# Altium schematic sheet GridSeed.SchDoc (part 1 of 2)
size A0; DocumentNumber: 1; SheetNumber: 1; SheetTotal: 1; SheetSize: A3
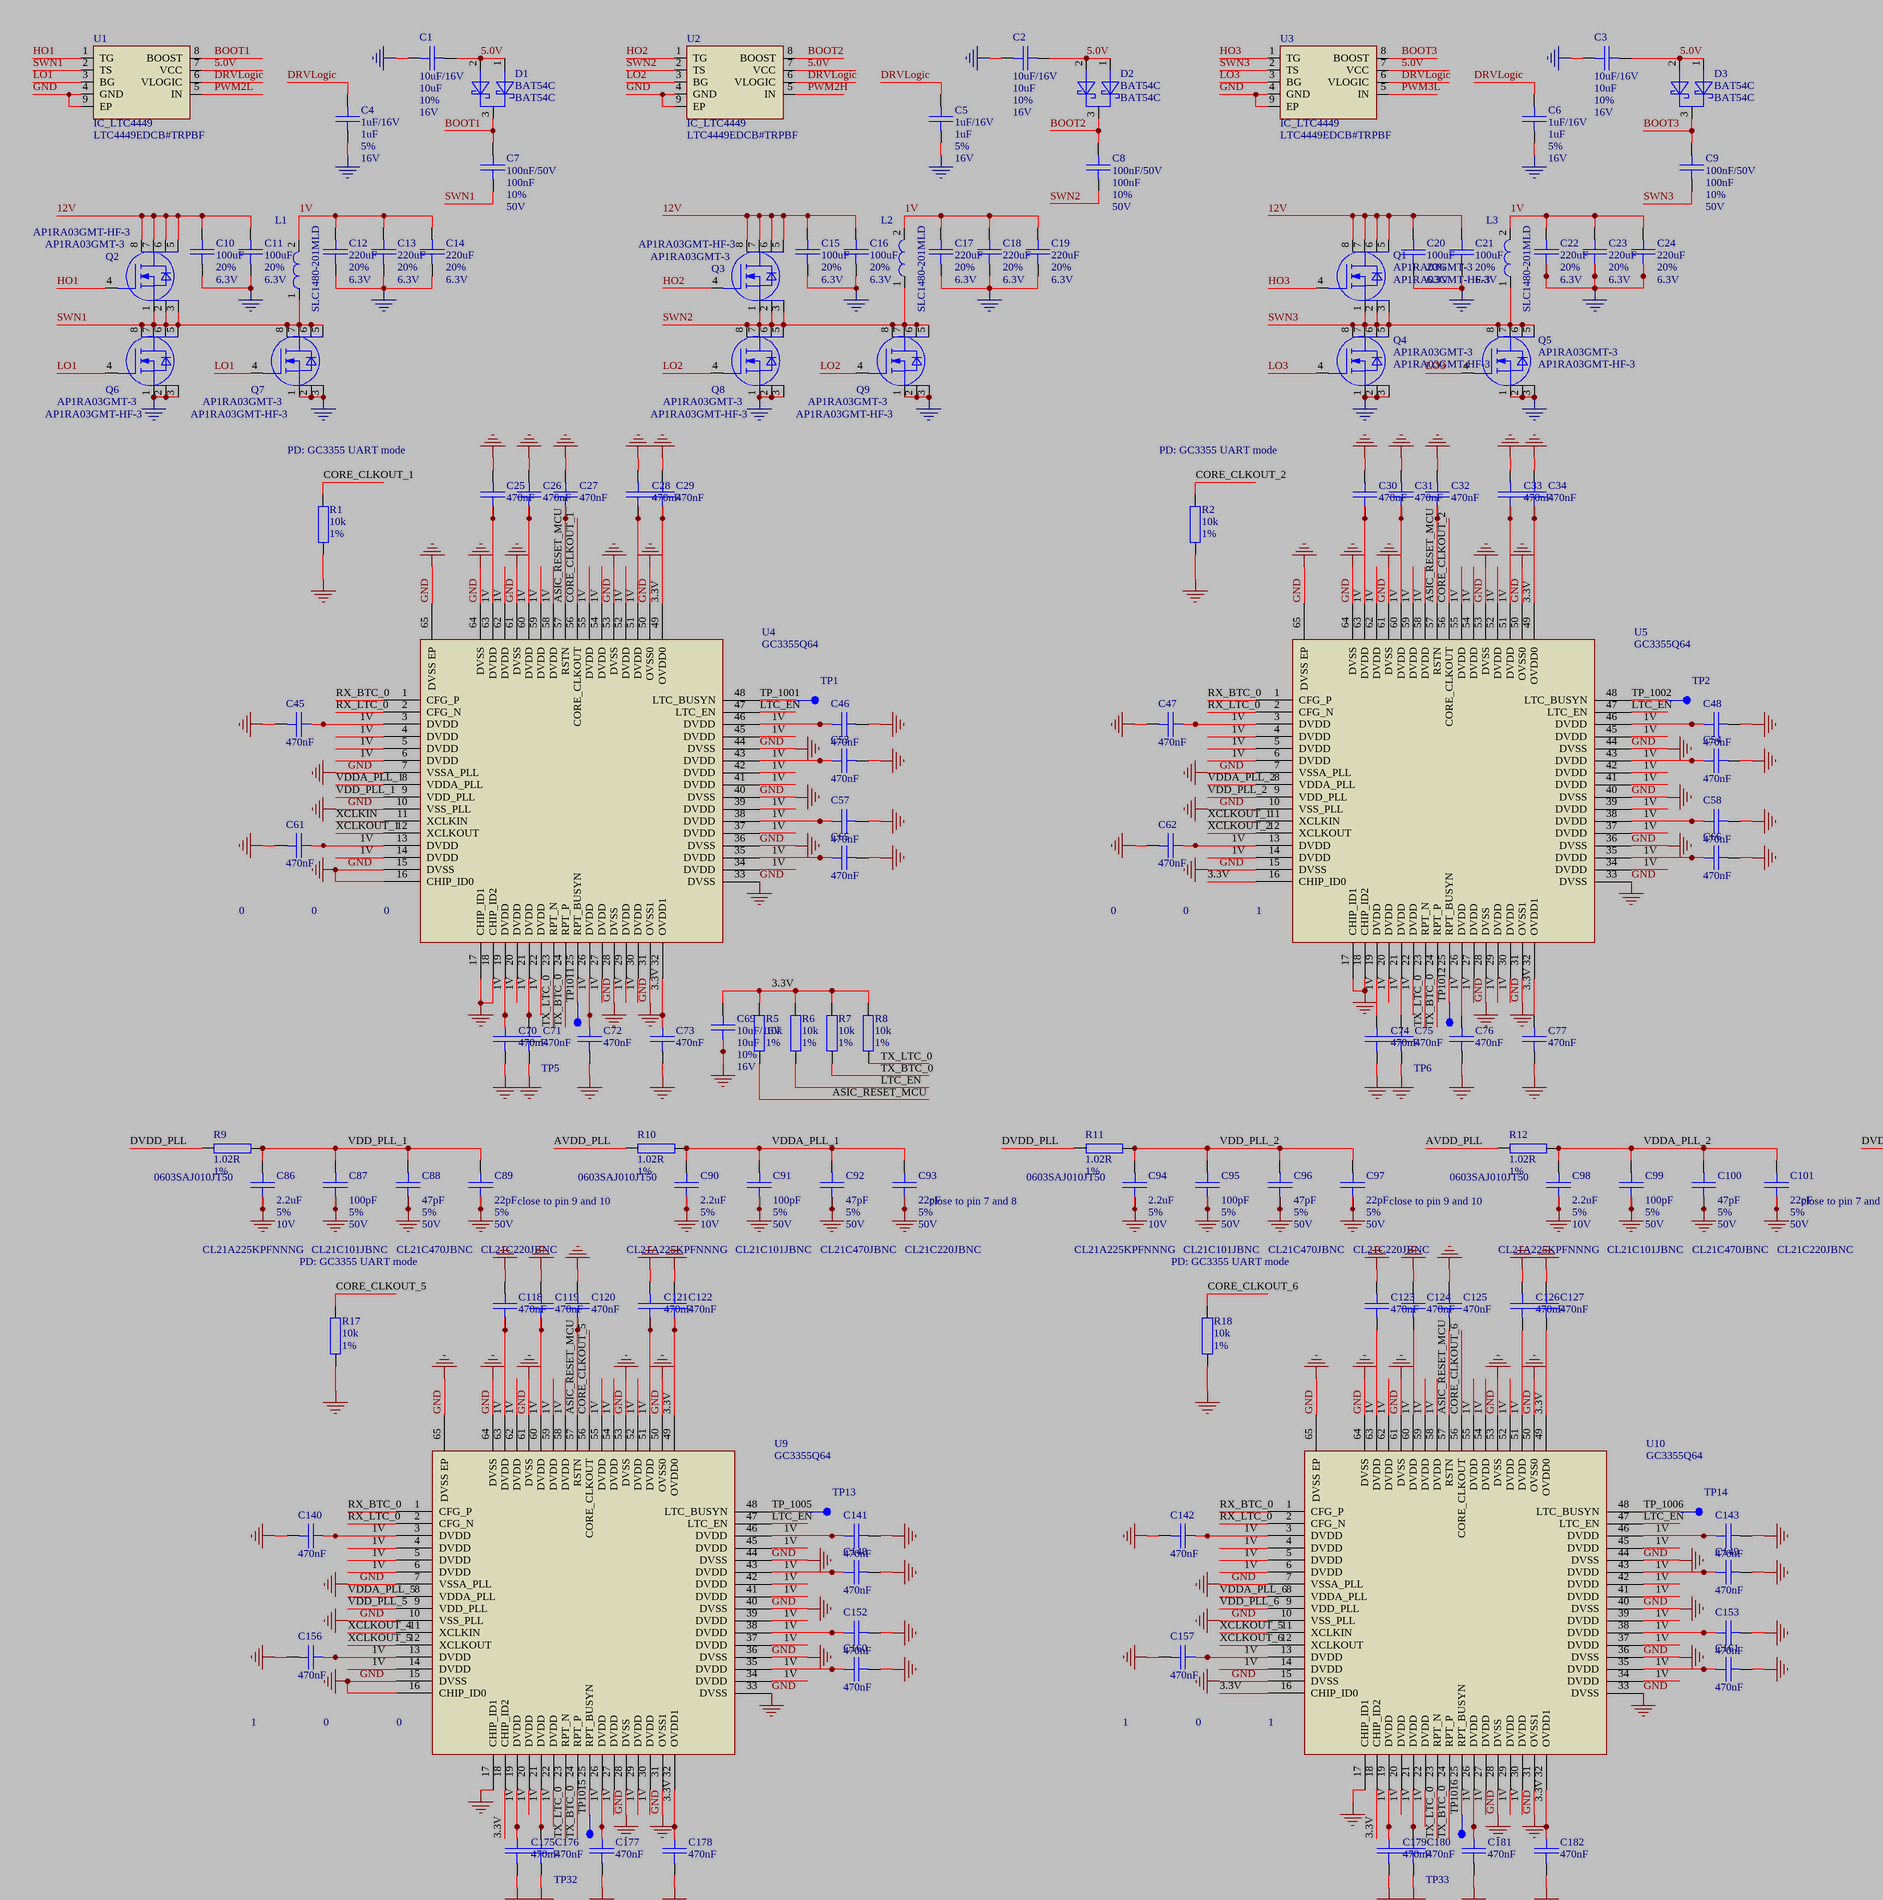
[diagram p0: GridSeed.SchDoc, top left]
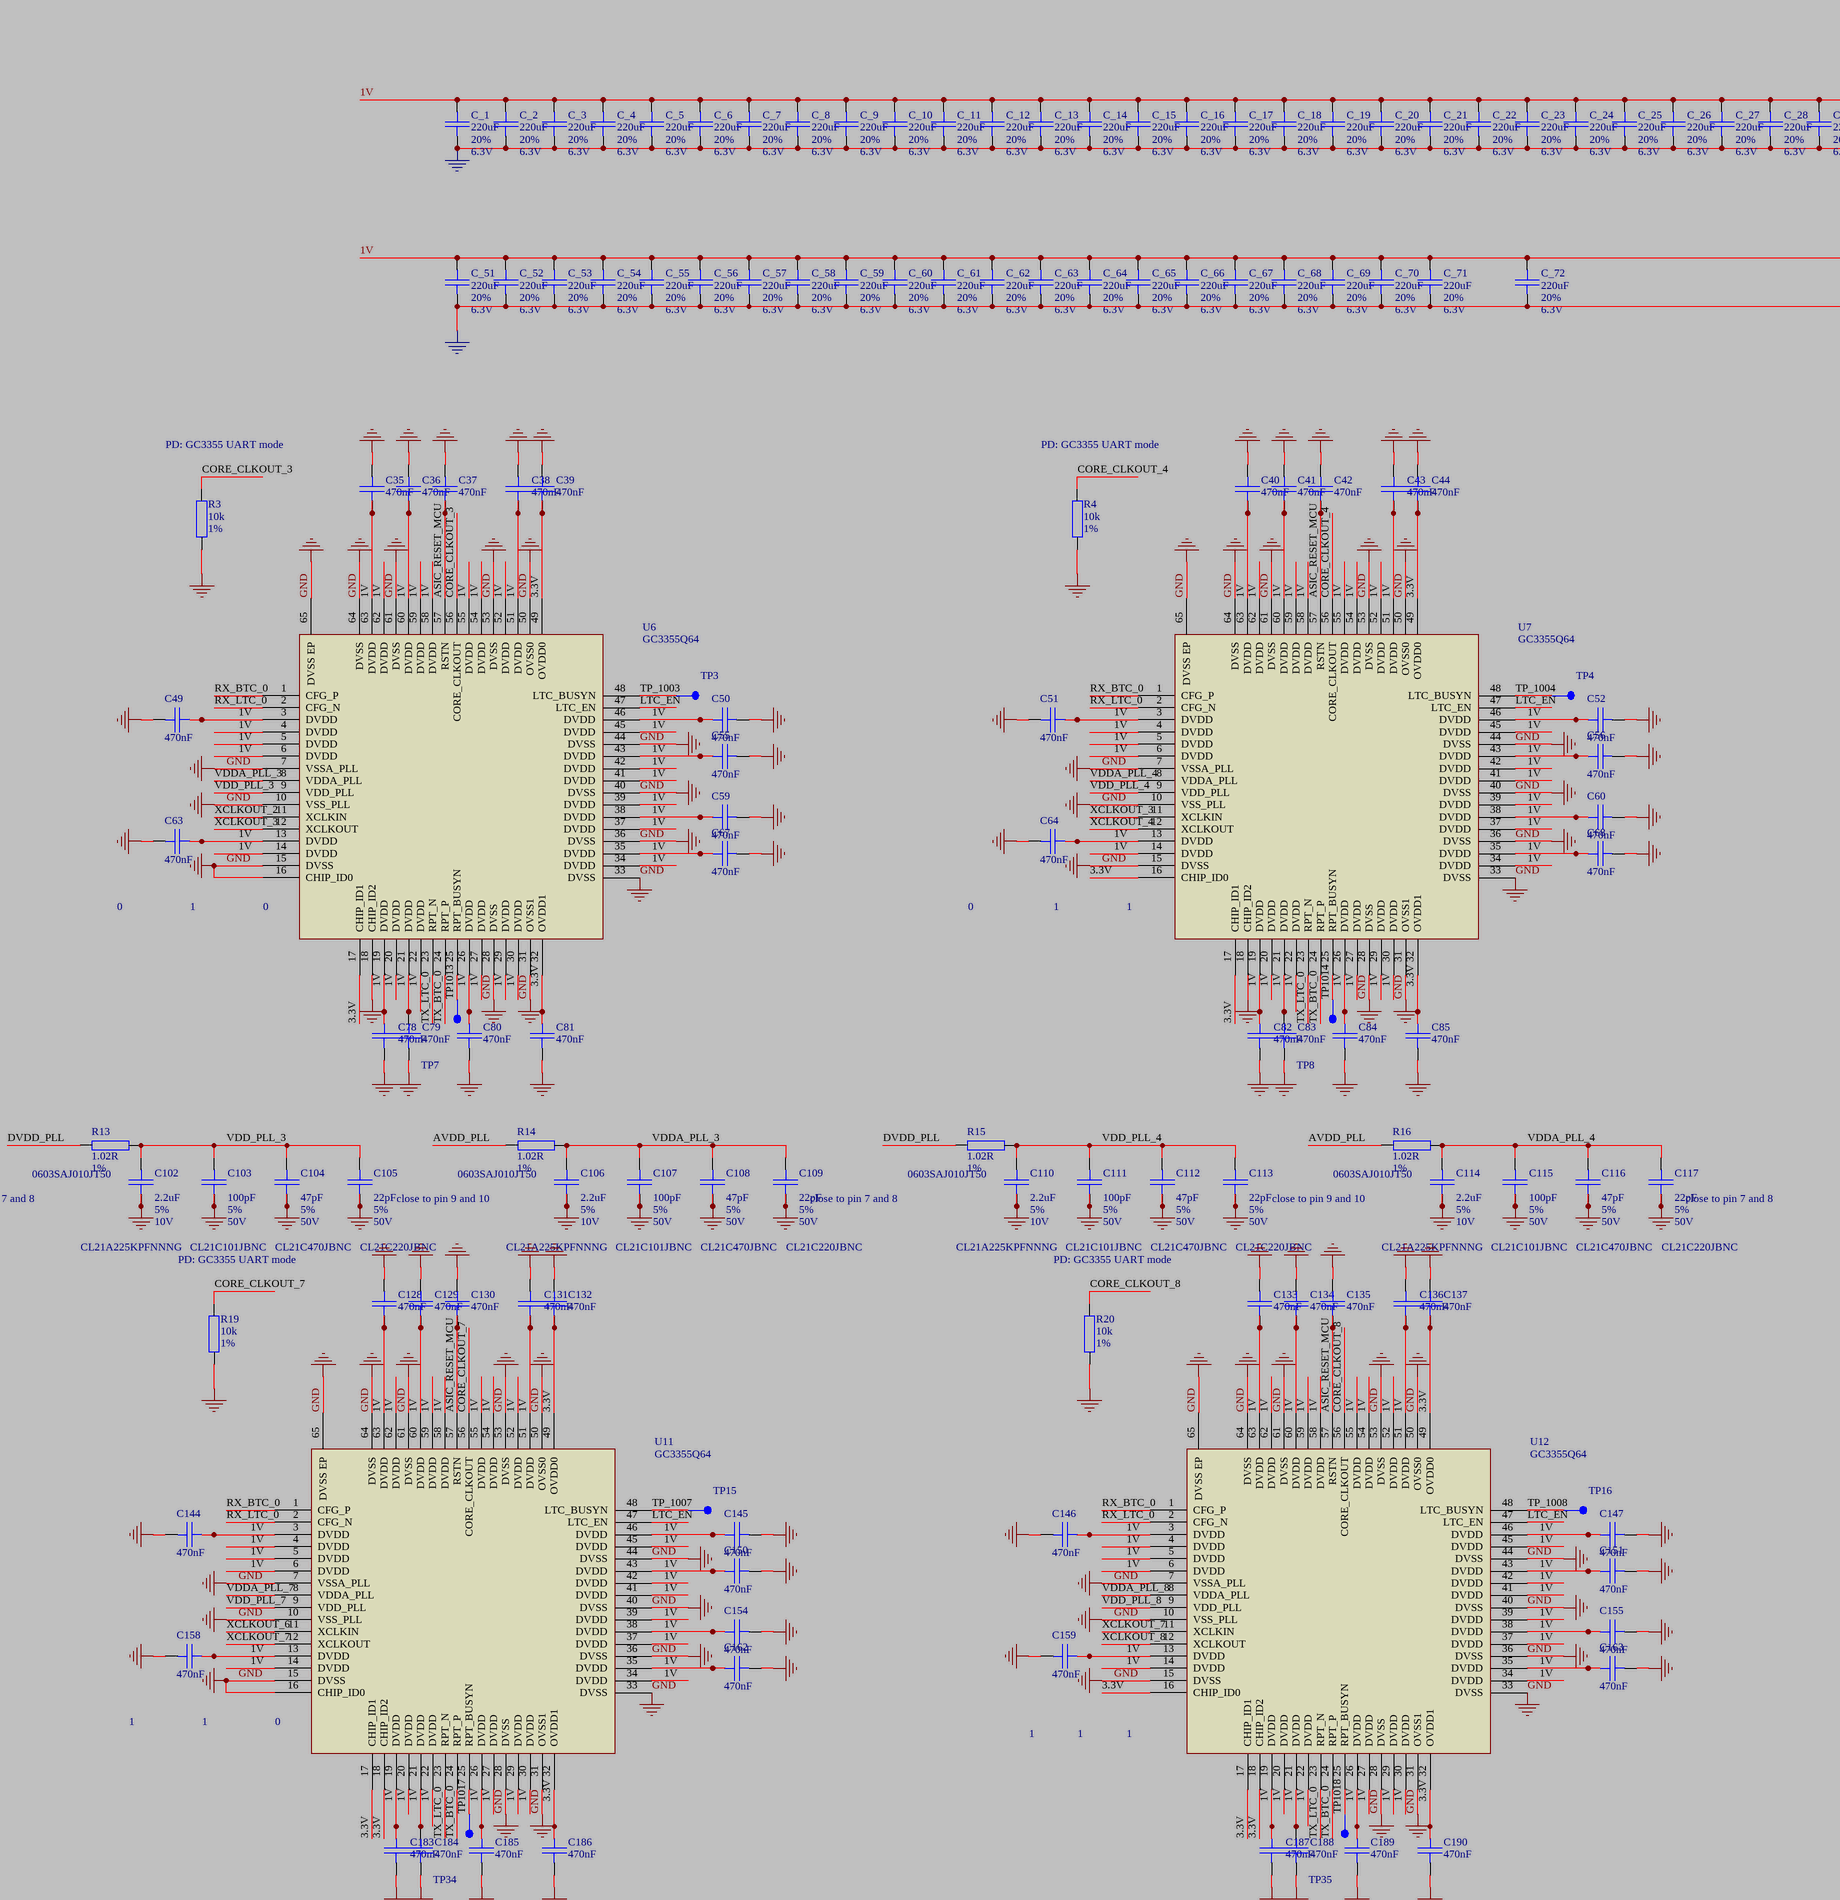
[diagram p1: GridSeed.SchDoc, top middle]
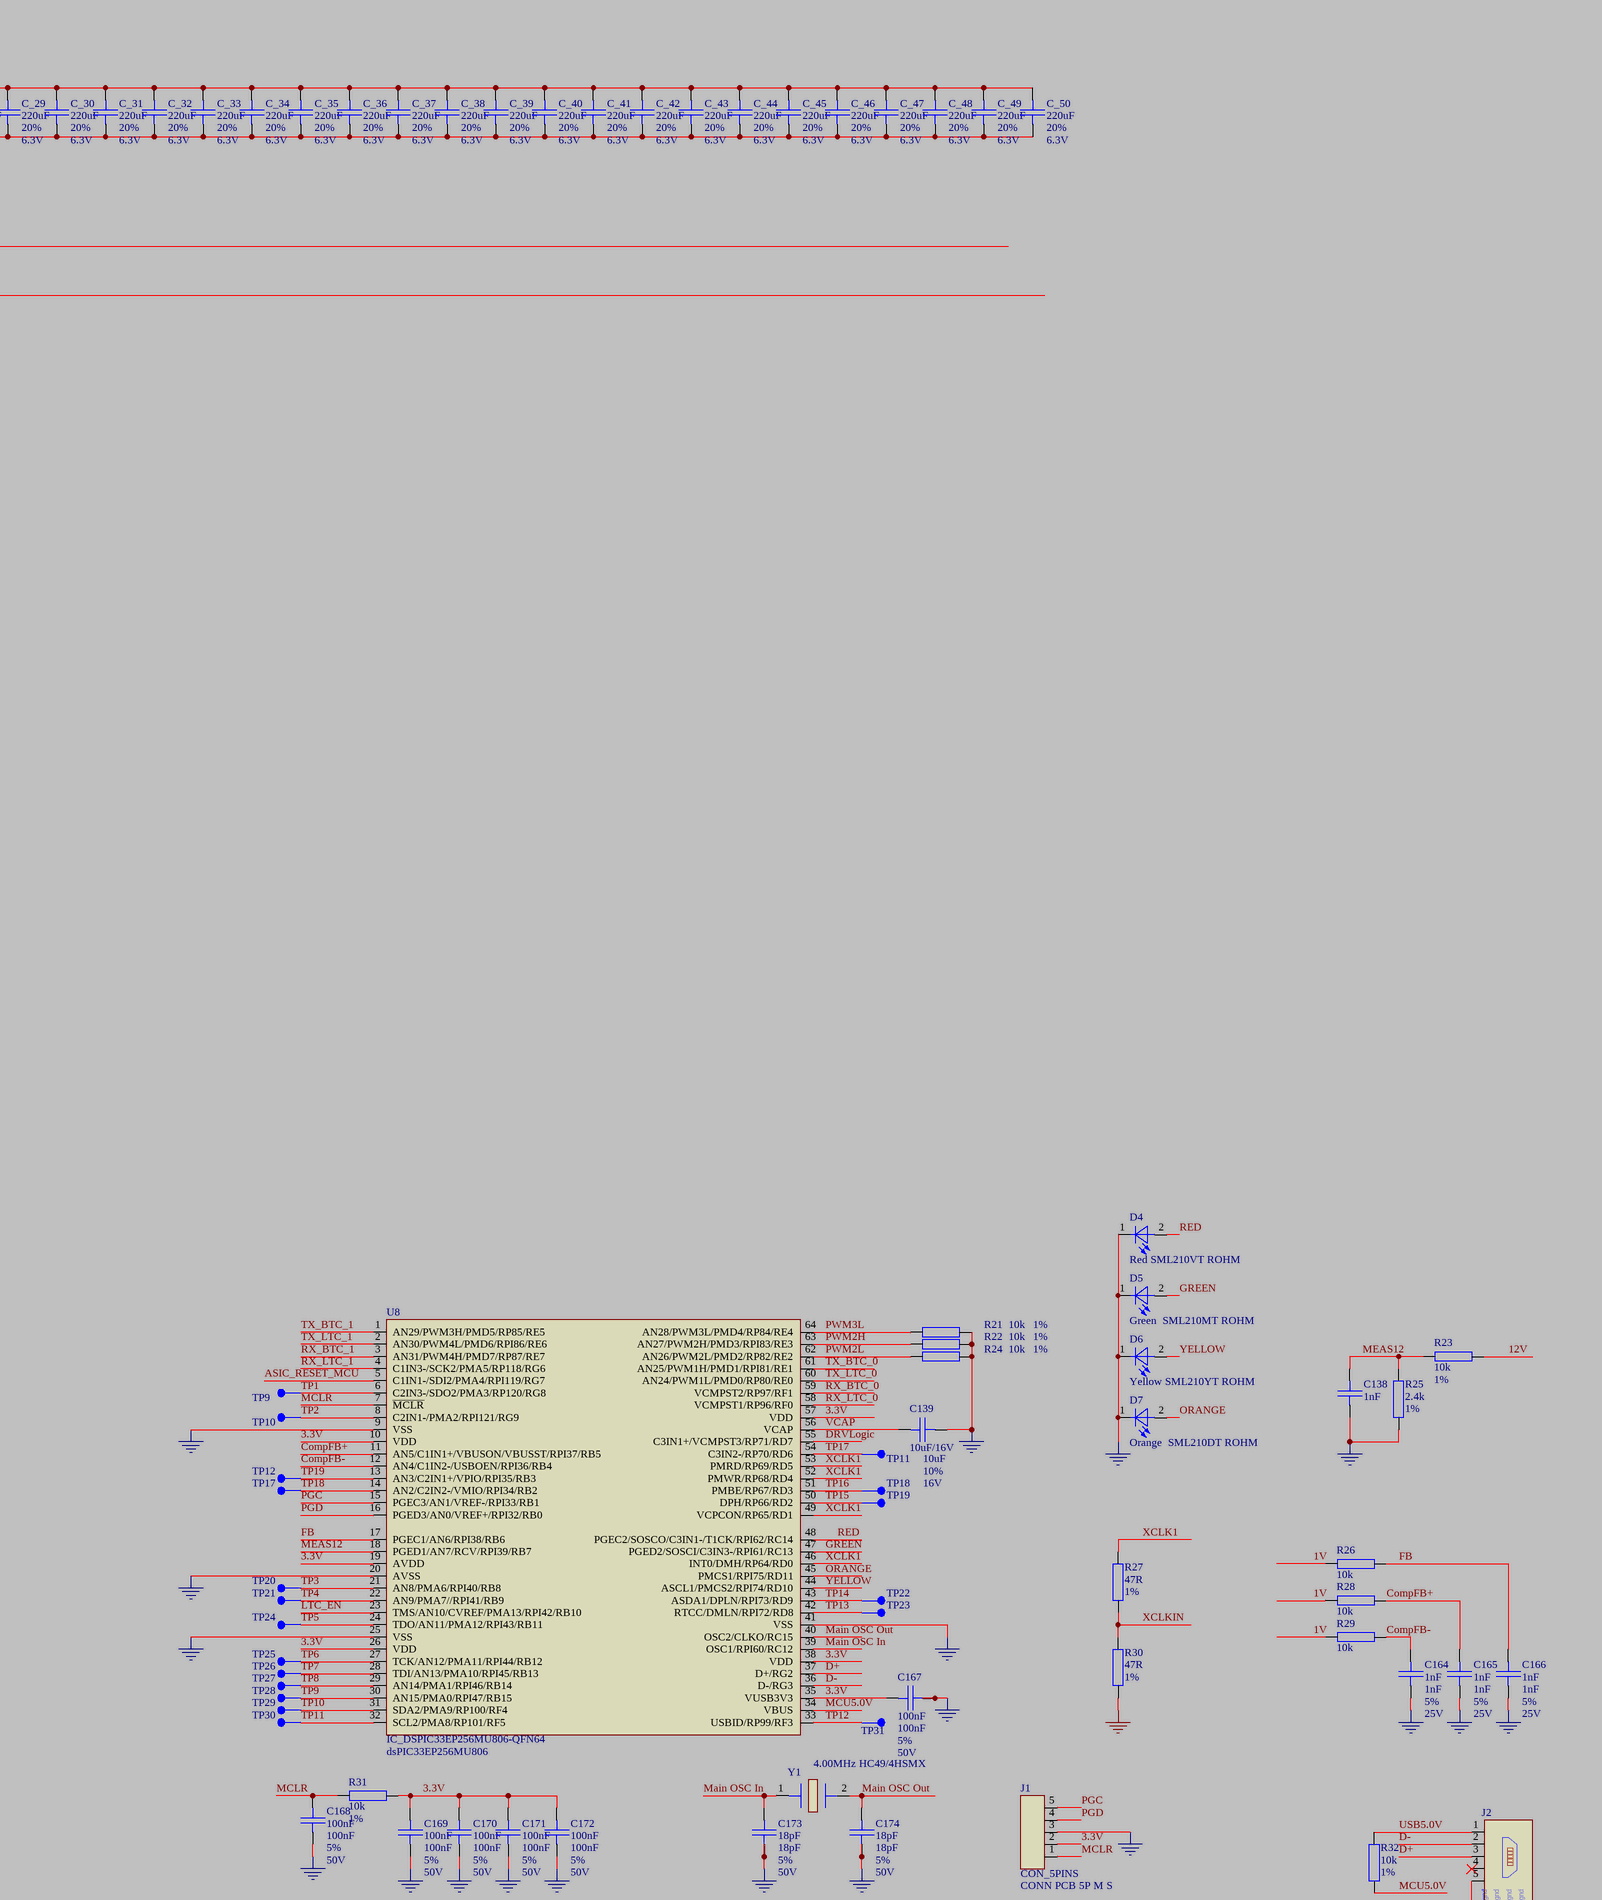
[diagram p2: GridSeed.SchDoc, top right]
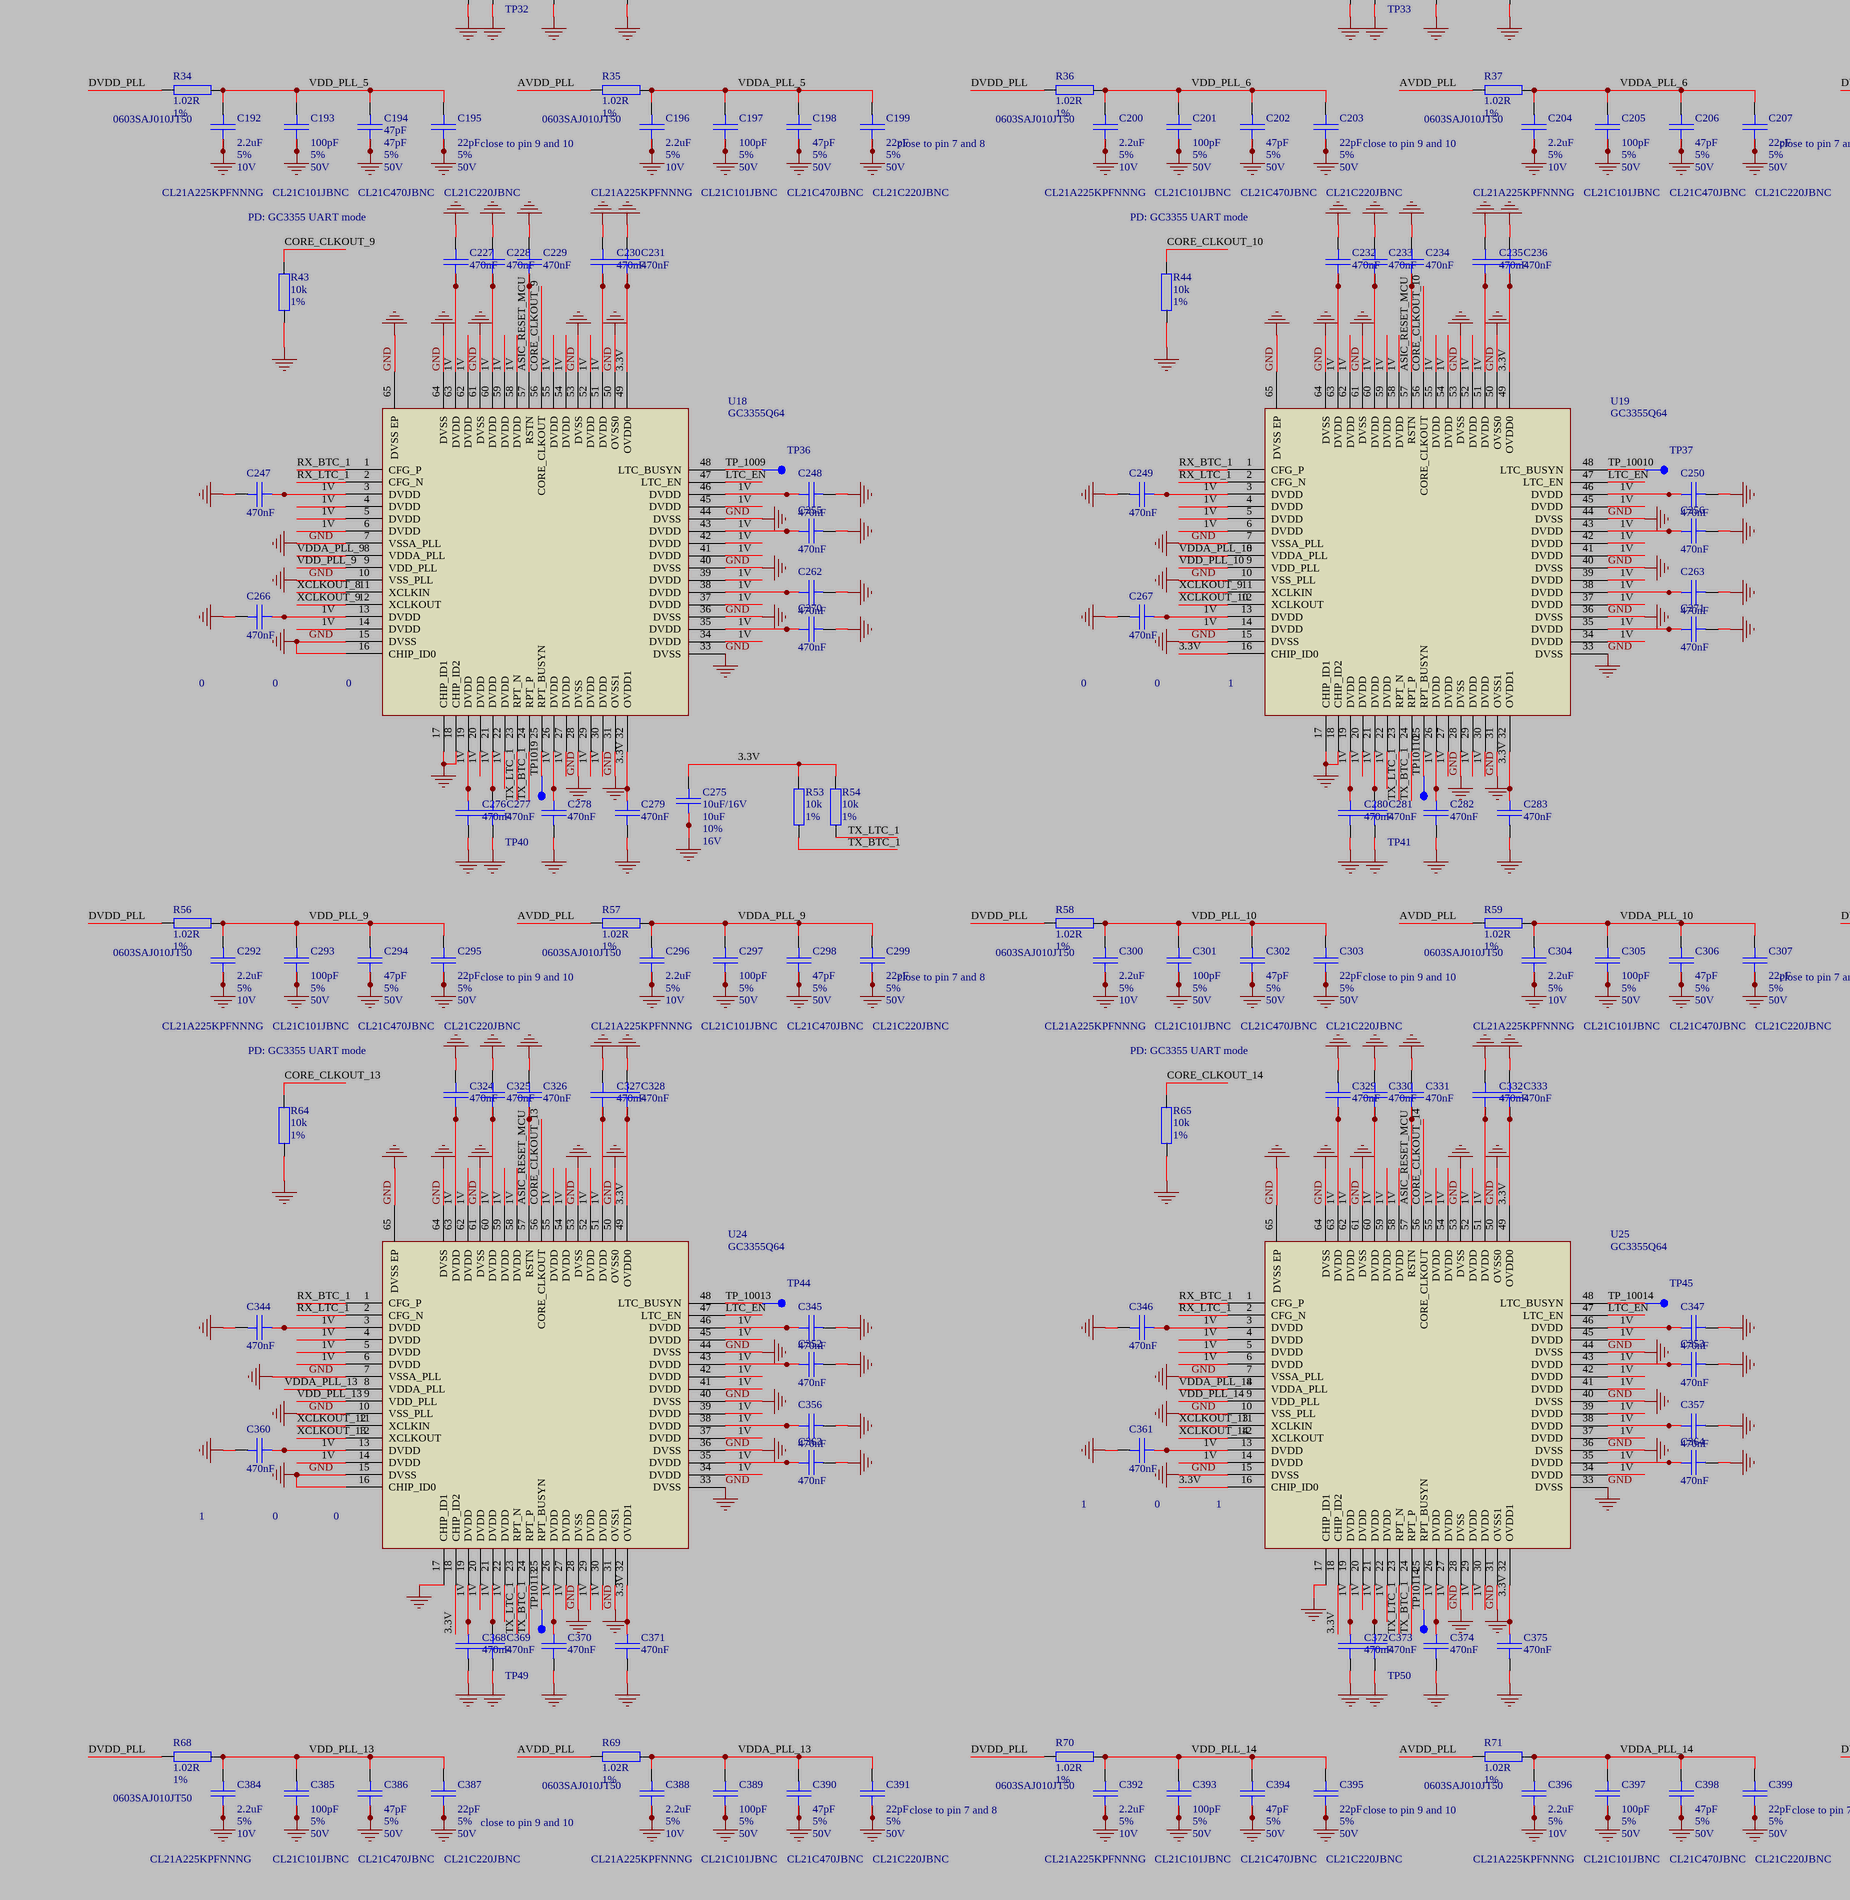
[diagram p3: GridSeed.SchDoc, bottom left]